# EAGLE schematic Mk4 Prototype (EAGLE 9.0.1)

## Sheet 1 of 4
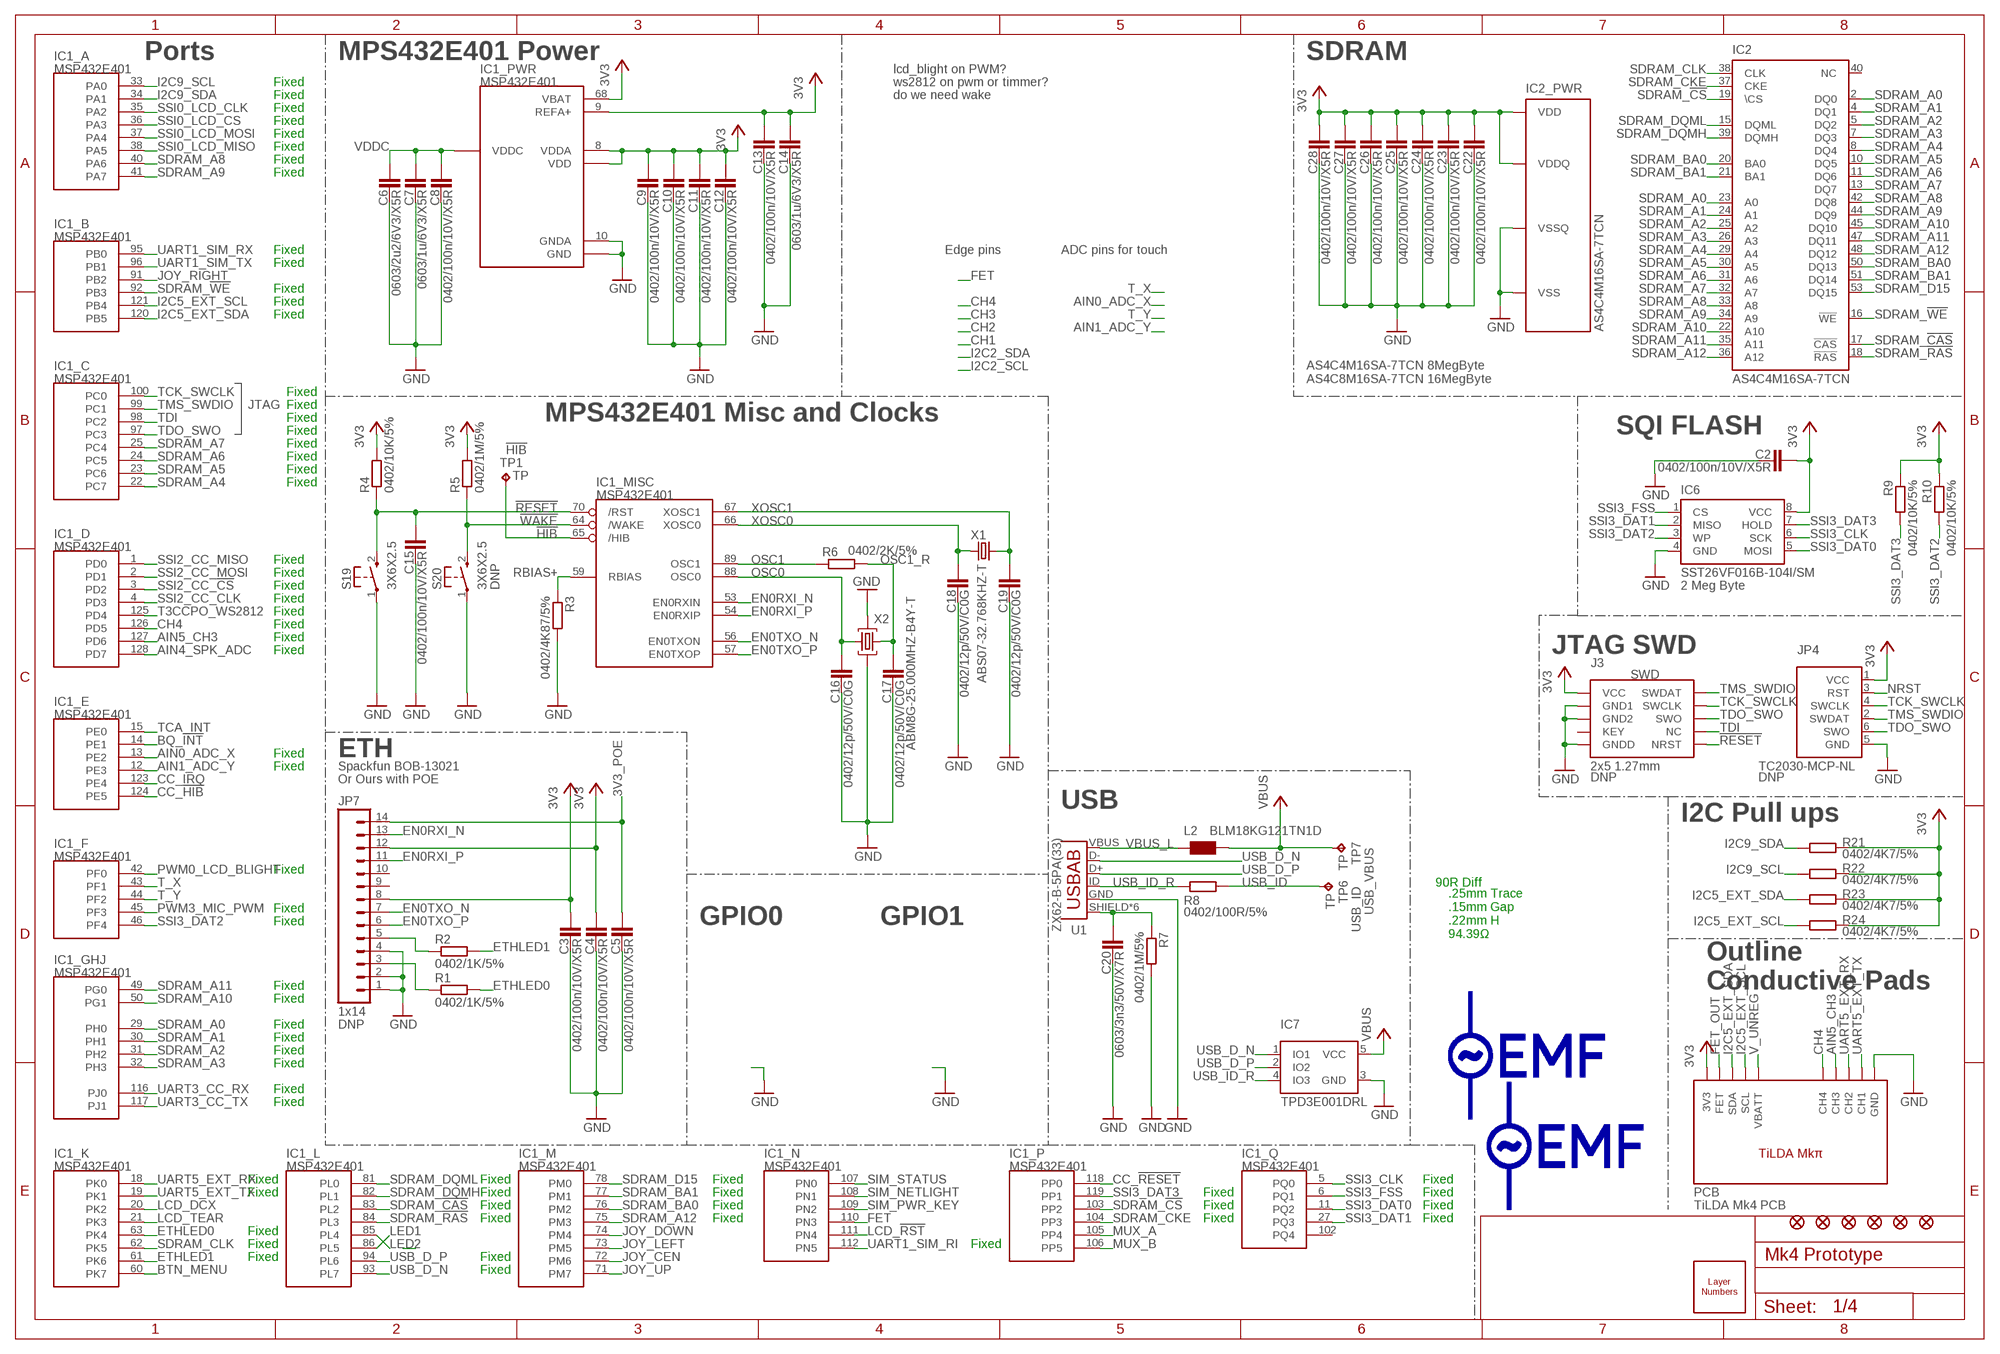
[diagram p0: schematic, sheet 1]

### Parts
C2  0402/100n/10V/X5R  C-EUC0402-SMALLER  [C0402-SMALLER]
C3  0402/100n/10V/X5R  C-EUC0402-SMALLER  [C0402-SMALLER]
C4  0402/100n/10V/X5R  C-EUC0402-SMALLER  [C0402-SMALLER]
C5  0402/100n/10V/X5R  C-EUC0402-SMALLER  [C0402-SMALLER]
C6  0603/2u2/6V3/X5R  C-EUC0603K-SMALL  [C0603K-SMALL]
C7  0603/1u/6V3/X5R  C-EUC0603K-SMALL  [C0603K-SMALL]
C8  0402/100n/10V/X5R  C-EUC0402-SMALLER  [C0402-SMALLER]
C9  0402/100n/10V/X5R  C-EUC0402-SMALLER  [C0402-SMALLER]
C10  0402/100n/10V/X5R  C-EUC0402-SMALLER  [C0402-SMALLER]
C11  0402/100n/10V/X5R  C-EUC0402-SMALLER  [C0402-SMALLER]
C12  0402/100n/10V/X5R  C-EUC0402-SMALLER  [C0402-SMALLER]
C13  0402/100n/10V/X5R  C-EUC0402-SMALLER  [C0402-SMALLER]
C14  0603/1u/6V3/X5R  C-EUC0603K-SMALL  [C0603K-SMALL]
C15  0402/100n/10V/X5R  C-EUC0402-SMALLER  [C0402-SMALLER]
C16  0402/12p/50V/C0G  C-EUC0402-SMALLER  [C0402-SMALLER]
C17  0402/12p/50V/C0G  C-EUC0402-SMALLER  [C0402-SMALLER]
C18  0402/12p/50V/C0G  C-EUC0402-SMALLER  [C0402-SMALLER]
C19  0402/12p/50V/C0G  C-EUC0402-SMALLER  [C0402-SMALLER]
C20  0603/3n3/50V/X7R  C-EUC0603K-SMALL  [C0603K-SMALL]
C22  0402/100n/10V/X5R  C-EUC0402-SMALLER  [C0402-SMALLER]
C23  0402/100n/10V/X5R  C-EUC0402-SMALLER  [C0402-SMALLER]
C24  0402/100n/10V/X5R  C-EUC0402-SMALLER  [C0402-SMALLER]
C25  0402/100n/10V/X5R  C-EUC0402-SMALLER  [C0402-SMALLER]
C26  0402/100n/10V/X5R  C-EUC0402-SMALLER  [C0402-SMALLER]
C27  0402/100n/10V/X5R  C-EUC0402-SMALLER  [C0402-SMALLER]
C28  0402/100n/10V/X5R  C-EUC0402-SMALLER  [C0402-SMALLER]
FID1  FIDUCIAL1X2.5-STOP  [FIDUCIAL-1X2.5-STOP]
FID2  FIDUCIAL1X2.5-STOP  [FIDUCIAL-1X2.5-STOP]
FID3  FIDUCIAL1X2.5-STOP  [FIDUCIAL-1X2.5-STOP]
FID4  FIDUCIAL1X2.5-STOP  [FIDUCIAL-1X2.5-STOP]
FID5  FIDUCIAL1X2.5-STOP  [FIDUCIAL-1X2.5-STOP]
FID6  FIDUCIAL1X2.5-STOP  [FIDUCIAL-1X2.5-STOP]
IC1  MSP432E401  [QFP128-0.4]
IC2  AS4C4M16SA-7TCN  MT48LCXXM16A2TG  [TSOP54-400]
IC6  SST26VF016B-104I/SM  SPI_FLASH-X25XXSMD1  [SO08-EIAJ]
IC7  TPD3E001DRL  [DRL-5]
J3  2x5 1.27mm  SWD_SHROUD-PINHEAD  [PINHEAD_2X05_127]
JP4  TC2030-MCP-NL  TC2030-SWDNL  [TC2030-MCP-NL]
JP7  1x14  M14LOCK  [1X14_LOCK]
L2  BLM18KG121TN1D  WE-CBF_0805  [WUERTH-0805]
LAYERS1  LAYER_NUMBRS_4_SMALL  [LAYER_NUMBERS_4_SMALL]
LOGO1  EMFLOGO-BOTH  [EMFLOGO]
PCB  TiLDA Mk4 PCB  TILDA_MK3_BOARDOUTLINE-MK4  [TILDA_MK4_OUTLINE]
R1  0402/1K/5%  R-EU_R0402-SMALLER  [R0402-SMALLER]
R2  0402/1K/5%  R-EU_R0402-SMALLER  [R0402-SMALLER]
R3  0402/4K87/5%  R-EU_R0402-SMALLER  [R0402-SMALLER]
R4  0402/10K/5%  R-EU_R0402-SMALLER  [R0402-SMALLER]
R5  0402/1M/5%  R-EU_R0402-SMALLER  [R0402-SMALLER]
R6  0402/2K/5%  R-EU_R0402-SMALLER  [R0402-SMALLER]
R7  0402/1M/5%  R-EU_R0402-SMALLER  [R0402-SMALLER]
R8  0402/100R/5%  R-EU_R0402-SMALLER  [R0402-SMALLER]
R9  0402/10K/5%  R-EU_R0402-SMALLER  [R0402-SMALLER]
R10  0402/10K/5%  R-EU_R0402-SMALLER  [R0402-SMALLER]
R21  0402/4K7/5%  R-EU_R0402-SMALLER  [R0402-SMALLER]
R22  0402/4K7/5%  R-EU_R0402-SMALLER  [R0402-SMALLER]
R23  0402/4K7/5%  R-EU_R0402-SMALLER  [R0402-SMALLER]
R24  0402/4K7/5%  R-EU_R0402-SMALLER  [R0402-SMALLER]
S19  3X6X2.5  TAC_SWITCH1-3X6X2.5  [TACTILE_SWITCH_SMD_3X6X2.5H]
S20  3X6X2.5  TAC_SWITCH1-3X6X2.5  [TACTILE_SWITCH_SMD_3X6X2.5H]
TP1  TP  TPB1,27  [B1,27]
TP6  TP  TPB1,27  [B1,27]
TP7  TP  TPB1,27  [B1,27]
U1  ZX62-B-5PA(33)  USB-AB-LWK  [USB-AB-MICRO-SMD_LWK]
X1  ABS07-32.768KHZ-T  RESONATOR_EPSON_FC_145  [RESONATOR_EPSON_FC_145]
X2  ABM8G-25.000MHZ-B4Y-T  CRYSTAL-3.2-2.5  [CRYSTAL-3.2-2.5]

### Nets
3V3: C2.2 C3.2 C4.2 C9.2 C10.2 C11.2 C12.2 C13.2 C14.2 C22.2 C23.2 C24.2 C25.2 C26.2 C27.2 C28.2 IC1.7(_PWR:VDD) IC1.8(_PWR:VDDA) IC1.9(_PWR:REFA+) IC1.16(_PWR:VDD) IC1.26(_PWR:VDD) IC1.28(_PWR:VDD) IC1.39(_PWR:VDD) IC1.47(_PWR:VDD) IC1.51(_PWR:VDD) IC1.52(_PWR:VDD) IC1.68(_PWR:VBAT) IC1.69(_PWR:VDD) IC1.79(_PWR:VDD) IC1.90(_PWR:VDD) IC1.101(_PWR:VDD) IC1.113(_PWR:VDD) IC1.122(_PWR:VDD) IC2.1(VDD) IC2.3(VDDQ) IC2.9(VDDQ) IC2.14(VDD) IC2.27(VDD) IC2.43(VDDQ) IC2.49(VDDQ) IC6.8(VCC) J3.1(VCC) JP4.1(VCC) JP7.8 JP7.12 PCB.3V3 R4.2 R5.2 R9.1 R10.1 R21.2 R22.2 R23.2 R24.2 ; also sheet 2,3,4
3V3_POE: C5.2 JP7.14
!HIB: IC1.65(_MISC:/HIB) TP1.TP
!RESET: C15.2 IC1.70(_MISC:/RST) J3.10(NRST) R4.1 S19.2
!WAKE: IC1.64(_MISC:/WAKE) R5.1 S20.2
AIN0_ADC_X: IC1.13(_E:PE2) ; also sheet 2
AIN1_ADC_Y: IC1.12(_E:PE3) ; also sheet 2
AIN4_SPK_ADC: IC1.128(_D:PD7) ; also sheet 4
AIN5_CH3: IC1.127(_D:PD6) PCB.CH2(CH3)
BQ_!INT: IC1.14(_E:PE1) ; also sheet 2
BTN_MENU: IC1.60(_K:PK7) ; also sheet 2
CC_!HIB: IC1.124(_E:PE5) ; also sheet 3
CC_!RESET: IC1.118(_P:PP0) ; also sheet 3
CC_IRQ: IC1.123(_E:PE4) ; also sheet 3
CH4: IC1.126(_D:PD5) PCB.CH1(CH4)
EN0RXI_N [100R Diff]: IC1.53(_MISC:EN0RXIN) JP7.13
EN0RXI_P [100R Diff]: IC1.54(_MISC:EN0RXIP) JP7.11
EN0TXO_N [100R Diff]: IC1.56(_MISC:EN0TXON) JP7.7
EN0TXO_P [100R Diff]: IC1.57(_MISC:EN0TXOP) JP7.6
ETHLED0: IC1.63(_K:PK4) R1.2
ETHLED0_R: JP7.3 R1.1
ETHLED1: IC1.61(_K:PK6) R2.2
ETHLED1_R: JP7.5 R2.1
FET: IC1.110(_N:PN3) ; also sheet 2
FET_OUT: PCB.FET ; also sheet 2
GND: C2.1 C3.1 C4.1 C5.1 C6.1 C7.1 C8.1 C9.1 C10.1 C11.1 C12.1 C13.1 C14.1 C15.1 C16.1 C17.1 C18.1 C19.1 C20.1 C22.1 C23.1 C24.1 C25.1 C26.1 C27.1 C28.1 IC1.10(_PWR:GNDA) IC1.17(_PWR:GND) IC1.48(_PWR:GND) IC1.55(_PWR:GND) IC1.58(_PWR:GND) IC1.80(_PWR:GND) IC1.114(_PWR:GND) IC2.6(VSSQ) IC2.12(VSSQ) IC2.28(VSS) IC2.41(VSS) IC2.46(VSSQ) IC2.52(VSSQ) IC2.54(VSS) IC6.4(GND) IC7.3(GND) J3.3(GND1) J3.5(GND2) J3.9(GNDD) JP4.5(GND) JP7.1 JP7.2 JP7.4 PCB.GND R3.2 R7.2 S19.1 S20.1 U1.GND X2.2(GND) X2.4(GND) ; also sheet 2,3,4
I2C5_EXT_SCL: IC1.121(_B:PB4) PCB.SCL R24.1
I2C5_EXT_SDA: IC1.120(_B:PB5) PCB.SDA R23.1
I2C9_SCL: IC1.33(_A:PA0) R22.1 ; also sheet 2
I2C9_SDA: IC1.34(_A:PA1) R21.1 ; also sheet 2
JOY_CEN: IC1.72(_M:PM6) ; also sheet 2
JOY_DOWN: IC1.74(_M:PM4) ; also sheet 2
JOY_LEFT: IC1.73(_M:PM5) ; also sheet 2
JOY_RIGHT: IC1.91(_B:PB2) ; also sheet 2
JOY_UP: IC1.71(_M:PM7) ; also sheet 2
LCD_!RST: IC1.111(_N:PN4) ; also sheet 2
LCD_DCX: IC1.20(_K:PK2) ; also sheet 2
LCD_TEAR: IC1.21(_K:PK3) ; also sheet 2
LED1: IC1.86(_L:PL5) ; also sheet 2
LED2: IC1.85(_L:PL4) ; also sheet 2
MUX_A: IC1.105(_P:PP4) ; also sheet 4
MUX_B: IC1.106(_P:PP5) ; also sheet 4
NRST: JP4.3(RST)
OSC0: C16.2 IC1.88(_MISC:OSC0) X2.1(C1)
OSC1: IC1.89(_MISC:OSC1) R6.1
OSC1_R: C17.2 R6.2 X2.3(C2)
PWM0_LCD_BLIGHT: IC1.42(_F:PF0) ; also sheet 2
PWM3_MIC_PWM: IC1.45(_F:PF3) ; also sheet 4
RBIAS+: IC1.59(_MISC:RBIAS) R3.1
SDRAM_!CAS: IC1.83(_L:PL2) IC2.17(!CAS)
SDRAM_!CS: IC1.103(_P:PP2) IC2.19(\CS)
SDRAM_!RAS: IC1.84(_L:PL3) IC2.18(!RAS)
SDRAM_!WE: IC1.92(_B:PB3) IC2.16(!WE)
SDRAM_A0: IC1.29(_GHJ:PH0) IC2.2(DQ0) IC2.23(A0)
SDRAM_A1: IC1.30(_GHJ:PH1) IC2.4(DQ1) IC2.24(A1)
SDRAM_A2: IC1.31(_GHJ:PH2) IC2.5(DQ2) IC2.25(A2)
SDRAM_A3: IC1.32(_GHJ:PH3) IC2.7(DQ3) IC2.26(A3)
SDRAM_A4: IC1.22(_C:PC7) IC2.8(DQ4) IC2.29(A4)
SDRAM_A5: IC1.23(_C:PC6) IC2.10(DQ5) IC2.30(A5)
SDRAM_A6: IC1.24(_C:PC5) IC2.11(DQ6) IC2.31(A6)
SDRAM_A7: IC1.25(_C:PC4) IC2.13(DQ7) IC2.32(A7)
SDRAM_A8: IC1.40(_A:PA6) IC2.33(A8) IC2.42(DQ8)
SDRAM_A9: IC1.41(_A:PA7) IC2.34(A9) IC2.44(DQ9)
SDRAM_A10: IC1.50(_GHJ:PG1) IC2.22(A10) IC2.45(DQ10)
SDRAM_A11: IC1.49(_GHJ:PG0) IC2.35(A11) IC2.47(DQ11)
SDRAM_A12: IC1.75(_M:PM3) IC2.36(A12) IC2.48(DQ12)
SDRAM_BA0: IC1.76(_M:PM2) IC2.20(BA0) IC2.50(DQ13)
SDRAM_BA1: IC1.77(_M:PM1) IC2.21(BA1) IC2.51(DQ14)
SDRAM_CKE: IC1.104(_P:PP3) IC2.37(CKE)
SDRAM_CLK: IC1.62(_K:PK5) IC2.38(CLK)
SDRAM_D15: IC1.78(_M:PM0) IC2.53(DQ15)
SDRAM_DQMH: IC1.82(_L:PL1) IC2.39(DQMH)
SDRAM_DQML: IC1.81(_L:PL0) IC2.15(DQML)
SIM_NETLIGHT: IC1.108(_N:PN1) ; also sheet 4
SIM_PWR_KEY: IC1.109(_N:PN2) ; also sheet 4
SIM_STATUS: IC1.107(_N:PN0) ; also sheet 4
SSI0_LCD_CLK: IC1.35(_A:PA2) ; also sheet 2
SSI0_LCD_CS: IC1.36(_A:PA3) ; also sheet 2
SSI0_LCD_MISO: IC1.38(_A:PA5) ; also sheet 2
SSI0_LCD_MOSI: IC1.37(_A:PA4) ; also sheet 2
SSI2_CC_!CS: IC1.3(_D:PD2) ; also sheet 3
SSI2_CC_CLK: IC1.4(_D:PD3) ; also sheet 3
SSI2_CC_MISO: IC1.1(_D:PD0) ; also sheet 3
SSI2_CC_MOSI: IC1.2(_D:PD1) ; also sheet 3
SSI3_CLK: IC1.5(_Q:PQ0) IC6.6(SCK)
SSI3_DAT0: IC1.11(_Q:PQ2) IC6.5(MOSI)
SSI3_DAT1: IC1.27(_Q:PQ3) IC6.2(MISO)
SSI3_DAT2: IC1.46(_F:PF4) IC6.3(WP) R10.2
SSI3_DAT3: IC1.119(_P:PP1) IC6.7(HOLD) R9.2
SSI3_FSS: IC1.6(_Q:PQ1) IC6.1(CS)
T3CCPO_WS2812: IC1.125(_D:PD4) ; also sheet 2
T_X: IC1.43(_F:PF1) ; also sheet 2
T_Y: IC1.44(_F:PF2) ; also sheet 2
TCA_INT: IC1.15(_E:PE0) ; also sheet 2
TCK_SWCLK: IC1.100(_C:PC0) J3.4(SWCLK) JP4.4(SWCLK)
TDI: IC1.98(_C:PC2) J3.8(NC)
TDO_SWO: IC1.97(_C:PC3) J3.6(SWO) JP4.6(SWO)
TMS_SWDIO: IC1.99(_C:PC1) J3.2(SWDAT) JP4.2(SWDAT)
UART1_SIM_RI: IC1.112(_N:PN5) ; also sheet 4
UART1_SIM_RX: IC1.95(_B:PB0) ; also sheet 4
UART1_SIM_TX: IC1.96(_B:PB1) ; also sheet 4
UART3_CC_RX: IC1.116(_GHJ:PJ0) ; also sheet 3
UART3_CC_TX: IC1.117(_GHJ:PJ1) ; also sheet 3
UART5_EXT_RX: IC1.18(_K:PK0) PCB.CH3(CH2)
UART5_EXT_TX: IC1.19(_K:PK1) PCB.CH4(CH1)
USB_D_N [90R Diff]: IC1.93(_L:PL7) IC7.1(IO1) U1.D-
USB_D_P [90R Diff]: IC1.94(_L:PL6) IC7.2(IO2) U1.D+
USB_ID: R8.2 TP6.TP
USB_ID_R: IC7.4(IO3) R8.1 U1.ID(USBID)
USB_SHIELD: C20.2 R7.1 U1.SHIELD U1.SHIELD@0(SHIELD) U1.SHIELD@1(SHIELD) U1.SHIELD@2(SHIELD) U1.SHIELD@3(SHIELD) U1.SHIELD@5(SHIELD)
V_UNREG: PCB.VBATT ; also sheet 2
VBUS: IC7.5(VCC) L2.2 TP7.TP ; also sheet 2
VBUS_L: L2.1 U1.VBUS
VDDC: C6.2 C7.2 C8.2 IC1.87(_PWR:VDDC) IC1.115(_PWR:VDDC)
XOSC0: C18.2 IC1.66(_MISC:XOSC0) X1.P$1
XOSC1: C19.2 IC1.67(_MISC:XOSC1) X1.P$2
Unconnected: IC1.102(_Q:PQ4) IC2.40(NC) J3.7(KEY) JP7.9 JP7.10

### Notes on the sheet
- Ports | MPS432E401 Power | SDRAM
- lcd_blight on PWM?
- Fixed | ws2812 on pwm or timmer?
- Fixed | do we need wake
- Fixed
- Fixed
- Fixed
- Fixed
- Fixed
- Fixed
- Fixed | Edge pins | ADC pins for touch
- Fixed
- Fixed
- Fixed
- Fixed
- AS4C4M16SA-7TCN 8MegByte
  AS4C8M16SA-7TCN 16MegByte
- Fixed
- JTAG | Fixed
- Fixed | MPS432E401 Misc and Clocks
- Fixed | SQI FLASH
- Fixed
- Fixed
- Fixed
- Fixed
- Fixed
- Fixed
- Fixed | 2 Meg Byte
- Fixed
- Fixed
- Fixed
- Fixed
- Fixed | JTAG SWD
- Fixed | ETH
- Fixed | Spackfun BOB-13021
- Or Ours with POE
- USB
- I2C Pull ups
- Fixed
- 90R Diff
- Fixed
- Fixed | GPIO0 | GPIO1
- .25mm Trace
  .15mm Gap
  .22mm H
  94.39Ω
- Fixed
- Outline
  Conductive Pads
- Fixed
- Fixed
- Fixed
- Fixed
- Fixed
- Fixed
- Fixed
- Fixed | Fixed | Fixed | Fixed
- Fixed | Fixed | Fixed | Fixed | Fixed
- Fixed | Fixed | Fixed | Fixed
- Fixed | Fixed | Fixed | Fixed
- Fixed
- Fixed | Fixed
- Fixed | Fixed
- Fixed

## Sheet 2 of 4
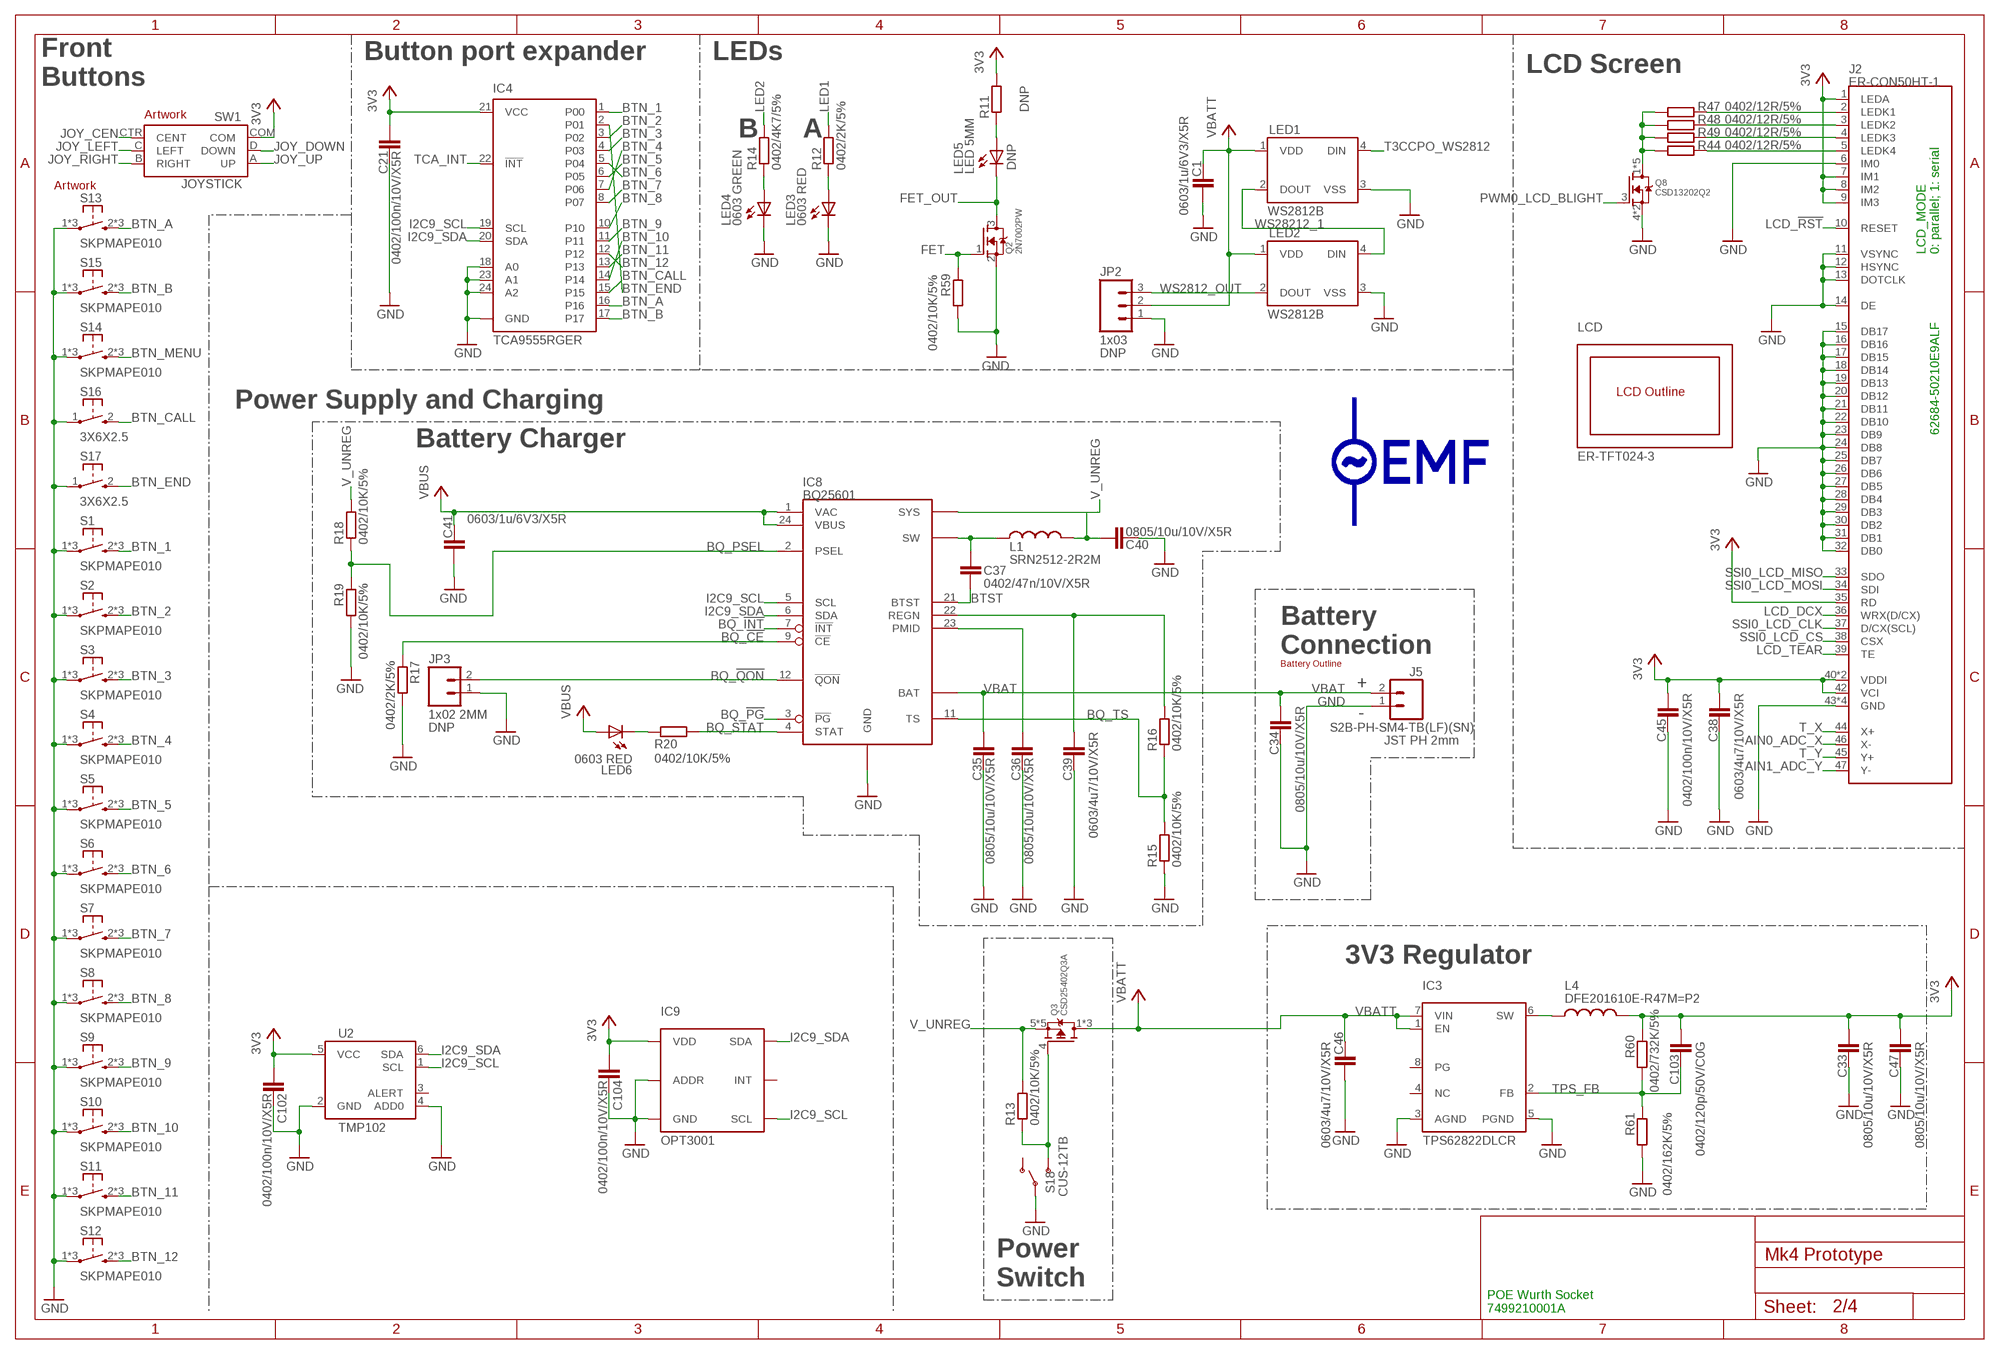
[diagram p1: schematic, sheet 2]

### Parts
ARTWORK1  ARTWORK_JOYSTICK  [TILDA_ARTWORK_JOYSTICK]
ARTWORK2  ARTWORK_KEYPAD  [TILDA_ARTWORK_KEYPAD]
BATT  1000mAh JST-PH  BATTERY-OUTLINE-32X50  [BATTERY-32X50]
C1  0603/1u/6V3/X5R  C-EUC0603K-SMALL  [C0603K-SMALL]
C21  0402/100n/10V/X5R  C-EUC0402-SMALLER  [C0402-SMALLER]
C33  0805/10u/10V/X5R  C-EUC0805-N  [C0805-N]
C34  0805/10u/10V/X5R  C-EUC0805-N  [C0805-N]
C35  0805/10u/10V/X5R  C-EUC0805-N  [C0805-N]
C36  0805/10u/10V/X5R  C-EUC0805-N  [C0805-N]
C37  0402/47n/10V/X5R  C-EUC0402-SMALLER  [C0402-SMALLER]
C38  0603/4u7/10V/X5R  C-EUC0603K-SMALL  [C0603K-SMALL]
C39  0603/4u7/10V/X5R  C-EUC0603K-SMALL  [C0603K-SMALL]
C40  0805/10u/10V/X5R  C-EUC0805-N  [C0805-N]
C41  0603/1u/6V3/X5R  C-EUC0603K-SMALL  [C0603K-SMALL]
C45  0402/100n/10V/X5R  C-EUC0402-SMALLER  [C0402-SMALLER]
C46  0603/4u7/10V/X5R  C-EUC0603K-SMALL  [C0603K-SMALL]
C47  0805/10u/10V/X5R  C-EUC0805-N  [C0805-N]
C102  0402/100n/10V/X5R  C-EUC0402-SMALLER  [C0402-SMALLER]
C103  0402/120p/50V/C0G  C-EUC0402-SMALLER  [C0402-SMALLER]
C104  0402/100n/10V/X5R  C-EUC0402-SMALLER  [C0402-SMALLER]
IC3  TPS62822DLCR  TPS62882  [VSON-HR]
IC4  TCA9555RGER  TCA9555  [QFN-24]
IC8  BQ25601  [QFN-24]
IC9  OPT3001  [USON-6]
J2  ER-CON50HT-1  ER-TFT024-3  [FH12-50S-0.5SH]
J5  S2B-PH-SM4-TB(LF)(SN)  M02-JST-2MM-SMT  [JST-2-SMD]
JP2  1x03  M03LOCK  [1X03_LOCK]
JP3  1x02 2MM  M022MM  [1X02_2MM]
L1  SRN2512-2R2M  INDUCTOR1008  [1008]
L4  DFE201610E-R47M=P2  INDUCTOR0806  [0806]
LCD  ER-TFT024-3  ER-TFT024-3-OUTLINE  [ER-TFT024-3]
LED1  WS2812B  [WS2812B]
LED2  WS2812B  [WS2812B]
LED3  0603 RED  LED0603-CORRECT  [LED-0603-CORRECT]
LED4  0603 GREEN  LED0603-CORRECT  [LED-0603-CORRECT]
LED5  LED 5MM  LED5MM  [LED5MM]
LED6  0603 RED  LED0603-CORRECT  [LED-0603-CORRECT]
Q2  2N7002PW  MOSFET-N-SC70-3  [SC70-3-R]
Q3  CSD25402Q3A  [Q3A]
Q8  CSD13202Q2  [Q2]
R11  R-EU_0309/10  [0309/10]
R12  0402/2K/5%  R-EU_R0402-SMALLER  [R0402-SMALLER]
R13  0402/10K/5%  R-EU_R0402-SMALLER  [R0402-SMALLER]
R14  0402/4K7/5%  R-EU_R0402-SMALLER  [R0402-SMALLER]
R15  0402/10K/5%  R-EU_R0402-SMALLER  [R0402-SMALLER]
R16  0402/10K/5%  R-EU_R0402-SMALLER  [R0402-SMALLER]
R17  0402/2K/5%  R-EU_R0402-SMALLER  [R0402-SMALLER]
R18  0402/10K/5%  R-EU_R0402-SMALLER  [R0402-SMALLER]
R19  0402/10K/5%  R-EU_R0402-SMALLER  [R0402-SMALLER]
R20  0402/10K/5%  R-EU_R0402-SMALLER  [R0402-SMALLER]
R44  0402/12R/5%  R-EU_R0402-SMALLER  [R0402-SMALLER]
R47  0402/12R/5%  R-EU_R0402-SMALLER  [R0402-SMALLER]
R48  0402/12R/5%  R-EU_R0402-SMALLER  [R0402-SMALLER]
R49  0402/12R/5%  R-EU_R0402-SMALLER  [R0402-SMALLER]
R59  0402/10K/5%  R-EU_R0402-SMALLER  [R0402-SMALLER]
R60  0402/732K/5%  R-EU_R0402-SMALLER  [R0402-SMALLER]
R61  0402/162K/5%  R-EU_R0402-SMALLER  [R0402-SMALLER]
S1  SKPMAPE010  TAC_SWITCH1-SKPM-COMBINED  [SKPMAPE010-COMBINED]
S2  SKPMAPE010  TAC_SWITCH1-SKPM-COMBINED  [SKPMAPE010-COMBINED]
S3  SKPMAPE010  TAC_SWITCH1-SKPM-COMBINED  [SKPMAPE010-COMBINED]
S4  SKPMAPE010  TAC_SWITCH1-SKPM-COMBINED  [SKPMAPE010-COMBINED]
S5  SKPMAPE010  TAC_SWITCH1-SKPM-COMBINED  [SKPMAPE010-COMBINED]
S6  SKPMAPE010  TAC_SWITCH1-SKPM-COMBINED  [SKPMAPE010-COMBINED]
S7  SKPMAPE010  TAC_SWITCH1-SKPM-COMBINED  [SKPMAPE010-COMBINED]
S8  SKPMAPE010  TAC_SWITCH1-SKPM-COMBINED  [SKPMAPE010-COMBINED]
S9  SKPMAPE010  TAC_SWITCH1-SKPM-COMBINED  [SKPMAPE010-COMBINED]
S10  SKPMAPE010  TAC_SWITCH1-SKPM-COMBINED  [SKPMAPE010-COMBINED]
S11  SKPMAPE010  TAC_SWITCH1-SKPM-COMBINED  [SKPMAPE010-COMBINED]
S12  SKPMAPE010  TAC_SWITCH1-SKPM-COMBINED  [SKPMAPE010-COMBINED]
S13  SKPMAPE010  TAC_SWITCH1-SKPM-COMBINED  [SKPMAPE010-COMBINED]
S14  SKPMAPE010  TAC_SWITCH1-SKPM-COMBINED  [SKPMAPE010-COMBINED]
S15  SKPMAPE010  TAC_SWITCH1-SKPM-COMBINED  [SKPMAPE010-COMBINED]
S16  3X6X2.5  TAC_SWITCH1-3X6X2.5  [TACTILE_SWITCH_SMD_3X6X2.5H]
S17  3X6X2.5  TAC_SWITCH1-3X6X2.5  [TACTILE_SWITCH_SMD_3X6X2.5H]
S18  CUS-12TB  SWITCH-SPST-SMD-A  [SWITCH-SPST-SMD-A]
SW1  JOYSTICK  JOYSTICK_MINI_MULTICOM_NOSILK  [JOYSTICK_MULTICOMP_NOSILK]
U2  TMP102  [SOT563]

### Nets
3V3: C21.2 C33.1 C38.2 C45.2 C47.1 C102.1 C103.1 C104.1 IC4.21(VCC) IC9.1(VDD) J2.1(LEDA) J2.7(IM1) J2.8(IM2) J2.9(IM3) J2.35(RD) J2.40(VDDI) J2.41(VDDI) J2.42(VCI) L4.2 R11.2 R60.1 SW1.COM U2.5(VCC) ; also sheet 1,3,4
AIN0_ADC_X: J2.46(X-) ; also sheet 1
AIN1_ADC_Y: J2.47(Y-) ; also sheet 1
BQ_!CE: IC8.9(!CE) R17.1
BQ_!INT: IC8.7(!INT) ; also sheet 1
BQ_!PG: IC8.3(!PG)
BQ_!QON: IC8.12(!QON) JP3.2
BQ_PMID: C36.1 IC8.23(PMID)
BQ_PSEL: IC8.2(PSEL) R18.1 R19.1
BQ_REGN: C39.2 IC8.22(REGN) R16.2
BQ_STAT: IC8.4(STAT) R20.1
BQ_STAT_R: LED6.C R20.2
BQ_SW: C37.2 IC8.19(SW) IC8.20(SW) L1.1
BQ_TS: IC8.11(TS) R15.2 R16.1
BTN_1: IC4.1(P00) S1.2 S1.B1 S1.B2
BTN_2: IC4.3(P02) S2.2 S2.B1 S2.B2
BTN_3: IC4.4(P03) S3.2 S3.B1 S3.B2
BTN_4: IC4.7(P06) S4.2 S4.B1 S4.B2
BTN_5: IC4.6(P05) S5.2 S5.B1 S5.B2
BTN_6: IC4.5(P04) S6.2 S6.B1 S6.B2
BTN_7: IC4.8(P07) S7.2 S7.B1 S7.B2
BTN_8: IC4.10 S8.2 S8.B1 S8.B2
BTN_9: IC4.11 S9.2 S9.B1 S9.B2
BTN_10: IC4.14 S10.2 S10.B1 S10.B2
BTN_11: IC4.13 S11.2 S11.B1 S11.B2
BTN_12: IC4.12 S12.2 S12.B1 S12.B2
BTN_A: IC4.16 S13.2 S13.B1 S13.B2
BTN_B: IC4.17 S15.2 S15.B1 S15.B2
BTN_CALL: IC4.15 S16.2
BTN_END: IC4.2(P01) S17.2
BTN_MENU: S14.2 S14.B1 S14.B2 ; also sheet 1
BTST: C37.1 IC8.21(BTST)
FET: Q2.1(G) R59.1 ; also sheet 1
FET_OUT: LED5.K(C) Q2.3(D) ; also sheet 1
GND: C1.2 C21.1 C33.2 C34.2 C35.2 C36.2 C38.1 C39.1 C40.2 C41.2 C45.1 C46.2 C47.2 C102.2 C104.2 IC3.3(AGND) IC3.5(PGND) IC4.9(GND) IC4.18(A0) IC4.23(A1) IC4.24(A2) IC4.25(GND) IC8.17(GND) IC8.18(GND) IC8.25(GND) IC9.2(ADDR) IC9.3(GND) IC9.PAD(GND) J2.6(IM0) J2.11(VSYNC) J2.12(HSYNC) J2.13(DOTCLK) J2.14(DE) J2.15(DB17) J2.16(DB16) J2.17(DB15) J2.18(DB14) J2.19(DB13) J2.20(DB12) J2.21(DB11) J2.22(DB10) J2.23(DB9) J2.24(DB8) J2.25(DB7) J2.26(DB6) J2.27(DB5) J2.28(DB4) J2.29(DB3) J2.30(DB2) J2.31(DB1) J2.32(DB0) J2.43(GND) J2.48(GND) J2.49(GND) J2.50(GND) J5.1 JP2.1 JP3.1 LED1.3(VSS) LED2.3(VSS) LED3.C LED4.C Q2.2(S) Q8.4(S) Q8.EP2(S) R15.1 R17.2 R19.2 R59.2 R61.2 S1.1 S1.A1 S1.A2 S2.1 S2.A1 S2.A2 S3.1 S3.A1 S3.A2 S4.1 S4.A1 S4.A2 S5.1 S5.A1 S5.A2 S6.1 S6.A1 S6.A2 S7.1 S7.A1 S7.A2 S8.1 S8.A1 S8.A2 S9.1 S9.A1 S9.A2 S10.1 S10.A1 S10.A2 S11.1 S11.A1 S11.A2 S12.1 S12.A1 S12.A2 S13.1 S13.A1 S13.A2 S14.1 S14.A1 S14.A2 S15.1 S15.A1 S15.A2 S16.1 S17.1 S18.2(P) U2.2(GND) U2.4(ADD0) ; also sheet 1,3,4
I2C9_SCL: IC4.19(SCL) IC8.5(SCL) IC9.4(SCL) U2.1(SCL) ; also sheet 1
I2C9_SDA: IC4.20(SDA) IC8.6(SDA) IC9.6(SDA) U2.6(SDA) ; also sheet 1
JOY_CEN: SW1.CTR(CENT) ; also sheet 1
JOY_DOWN: SW1.D(DOWN) ; also sheet 1
JOY_LEFT: SW1.C(LEFT) ; also sheet 1
JOY_RIGHT: SW1.B(RIGHT) ; also sheet 1
JOY_UP: SW1.A(UP) ; also sheet 1
LCD_!RST: J2.10(RESET) ; also sheet 1
LCD_DCX: J2.36(WRX(D/CX)) ; also sheet 1
LCD_TEAR: J2.39(TE) ; also sheet 1
LED1: R12.2 ; also sheet 1
LED1_R: LED3.A R12.1
LED2: R14.2 ; also sheet 1
LED2_R: LED4.A R14.1
LED5_R: LED5.A R11.1
LEDK: Q8.1(D) Q8.2(D) Q8.5(D) Q8.6(D) Q8.EP1(D) R44.1 R47.1 R48.1 R49.1
LEDK1: J2.2(LEDK1) R47.2
LEDK2: J2.3(LEDK2) R48.2
LEDK3: J2.4(LEDK3) R49.2
LEDK4: J2.5(LEDK4) R44.2
POWER_SWITCH: Q3.4(G) R13.1 S18.3(S)
PWM0_LCD_BLIGHT: Q8.3(G) ; also sheet 1
SSI0_LCD_CLK: J2.37(D/CX(SCL)) ; also sheet 1
SSI0_LCD_CS: J2.38(CSX) ; also sheet 1
SSI0_LCD_MISO: J2.33(SDO) ; also sheet 1
SSI0_LCD_MOSI: J2.34(SDI) ; also sheet 1
SW: IC3.6(SW) L4.1
T3CCPO_WS2812: LED1.4(DIN) ; also sheet 1
T_X: J2.44(X+) ; also sheet 1
T_Y: J2.45(Y+) ; also sheet 1
TCA_INT: IC4.22(!INT) ; also sheet 1
TPS_FB: C103.2 IC3.2(FB) R60.2 R61.1
V_UNREG: C40.1 IC8.15(SYS) IC8.16(SYS) L1.2 Q3.5(S) Q3.6(S) Q3.7(S) Q3.8(S) Q3.EP(S) R13.2 R18.2 ; also sheet 1
VBAT: C34.1 C35.1 IC8.13(BAT) IC8.14(BAT) J5.2
VBATT: C1.1 C46.1 IC3.1(EN) IC3.7(VIN) JP2.2 LED1.1(VDD) LED2.1(VDD) Q3.1(D) Q3.2(D) Q3.3(D) ; also sheet 4
VBUS: C41.1 IC8.1(VAC) IC8.24(VBUS) LED6.A ; also sheet 1
WS2812_OUT: JP2.3 LED2.2(DOUT)
WS28212_1: LED1.2(DOUT) LED2.4(DIN)
Unconnected: IC3.4(NC) IC3.8(PG) IC9.5(INT) S18.1(O) U2.3(ALERT)

### Notes on the sheet
- Button port expander | LEDs
- LCD Screen
- Front 
  Buttons
- B | A
- LCD_MODE
  0: parallel; 1: serial
- Power Supply and Charging
- 62684-50210E9ALF
- Battery Charger
- Battery
  Connection
- +
- -
- JST PH 2mm
- 3V3 Regulator
- Power 
  Switch
- POE Wurth Socket
  7499210001A

## Sheet 3 of 4